# EasyEDA Pro project ProProject_Avaota Pi A_2024-03-25.epro, board PCB2
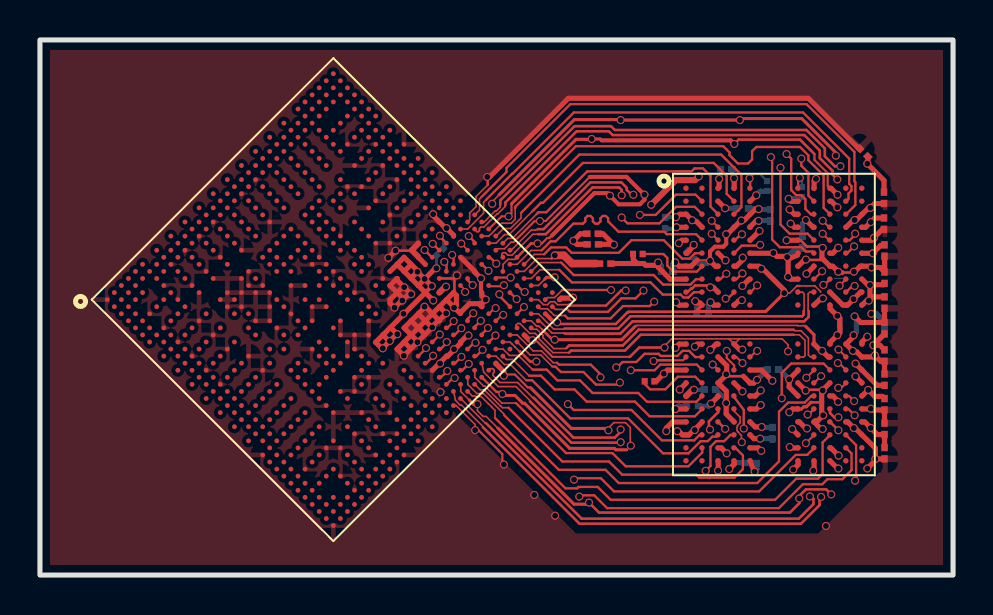
[diagram p19: board, top side]
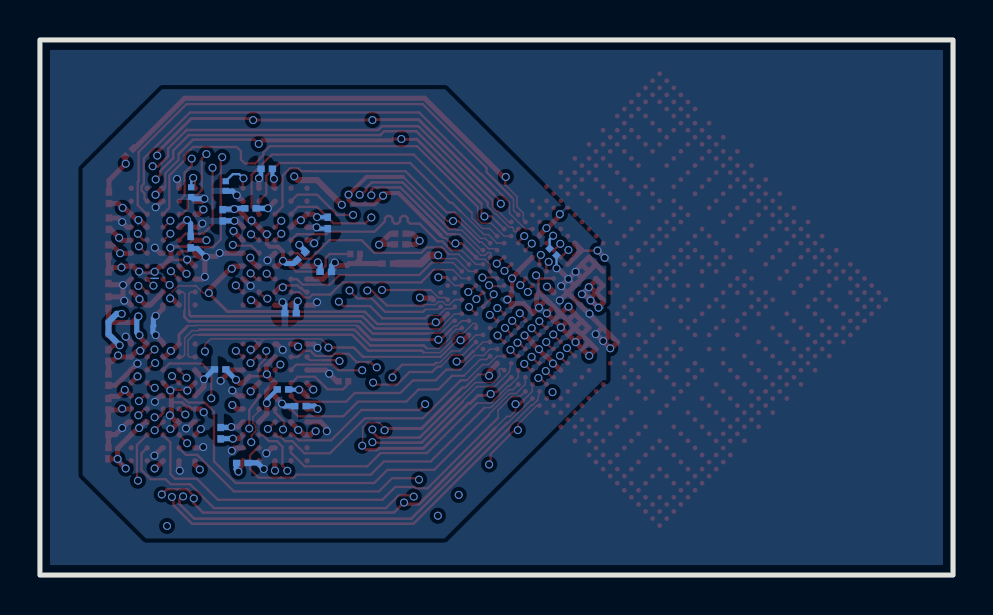
[diagram p20: board, bottom side, seen from below]

Outline 45.69 x 26.8 mm; copper layers: Top Layer, Inner1, Inner2, Bottom Layer. Coordinates in mm from the lower left corner of the outline.
Outline path: rectangle 0,26.8 45.69,0
Stack: Top Layer 0.035mm 外层铜厚1oz / Dielectric1 0.2104mm 7628 RC49% 8.6mil / Inner1 0.0152mm 内层铜厚 / Dielectric2 1.065mm 1.1mm H/HOZ 含铜 / Inner2 0.0152mm 内层铜厚 / Dielectric3 0.2104mm 7628 RC49% 8.6mil / Bottom Layer 0.035mm 外层铜厚1oz

## Design rules (mm)
template: 6L BGA
spacing safeClearance (default): track to track 0.076, other pairs 0.076 to 0.3
track width trackWidth (default): min 0.076, default 0.102, max 2.54
differential pair differentialPair (default): width min 0.102, default 0.254, max 2.54; gap min 0.102, default 0.102
via viaSize (default): diameter min 0.381, default 0.45, max 10; hole min 0.201, default 0.201, max 5.999
net GND uses DRAMCopper
pour e3959 uses DRAMCopper
pour e3975 uses DRAMCopper

## Placement (name value [footprint] x y rotation side)
C1  2.2uF  [c0201 nsk]  42.27 13.64 270 top
C2  2.2uF  [c0201 nsk]  42.27 6.1 270 top
C3  100nF  [c0201 nsk]  42.27 14.88 270 top
C4  100nF  [c0201 nsk]  42.27 9.78 270 top
C5  100nF  [c0201 nsk]  28.3 15.6 0 top
C6  2.2uF  [c0201 nsk]  41.22 21.16 135 top
C7  100nF  [c0201 nsk]  42.24 18.9 90 top
C8  2.2uF  [c0201 nsk]  42.27 12.37 90 top
C9  100nF  [c0201 nsk]  42.27 16.26 90 top
C10  100nF  [c0201 nsk]  32.61 15.98 135 bottom
C11  100nF  [c0201 nsk]  42.27 8.56 90 top
C12  100nF  [c0201 nsk]  42.27 11 90 top
C13  100nF  [c0201 nsk]  33.53 9.3 180 bottom
C14  2.2uF  [c0201 nsk]  34.34 20.34 180 bottom
C15  2.2uF  [c0201 nsk]  33.15 13.11 180 bottom
C16  100nF  [c0201 nsk]  31.29 17.63 270 bottom
C17  100nF  [c0201 nsk]  42.24 17.6 90 top
C18  100nF  [c0201 nsk]  42.27 7.31 270 top
C19  2.2uF  [c0201 nsk]  31.39 15.19 0 bottom
C20  100nF  [c0201 nsk]  36.68 10.3 0 bottom
C21  100nF  [c0201 nsk]  35.56 5.61 180 bottom
C22  100nF  [c0201 nsk]  32.66 8.46 0 bottom
C23  100nF  [c0201 nsk]  38.15 16.66 270 bottom
C24  100nF  [c0201 nsk]  36.65 7.11 90 bottom
C25  100nF  [c0201 nsk]  36.55 18.01 270 bottom
C26  100nF  [c0201 nsk]  35.15 18.36 180 bottom
C27  2.2uF  [c0201 nsk]  27.66 17.09 0 top
C28  100nF  [c0201 nsk]  27.66 16.56 180 top
R1  0  [r0201 nsk]  29.92 16.08 180 top
R2  0  [r0201 nsk]  30.51 9.7 0 top
R3  120  [r0201 nsk]  20.01 16.18 225 bottom
R4  240  [r0201 nsk]  36.4 19.48 270 bottom
R5  240  [r0201 nsk]  38.13 19.18 270 bottom
U1  T527  [T527-BGA664]  14.68 13.79 45 top
UD1  LPDDR4_FBGA200  [BGA200P65_80B1000_1500H90]  36.73 12.55 0 top

## Footprints (pads in the part's own frame, mm; a bottom-side part is the same pattern mirrored in y, then rotated)
BGA200P65_80B1000_1500H90
  round 0.27 smd: A1(-4.4,6.825) A2(-3.6,6.825) A3(-2.8,6.825) A4(-2,6.825) A5(-1.2,6.825) A8(1.2,6.825) A9(2,6.825) A10(2.8,6.825) A11(3.6,6.825) A12(4.4,6.825) AA1(-4.4,-6.175) AA2(-3.6,-6.175) AA3(-2.8,-6.175) AA4(-2,-6.175) AA5(-1.2,-6.175) AA8(1.2,-6.175) AA9(2,-6.175) AA10(2.8,-6.175) AA11(3.6,-6.175) AA12(4.4,-6.175) AB1(-4.4,-6.825) AB2(-3.6,-6.825) AB3(-2.8,-6.825) AB4(-2,-6.825) AB5(-1.2,-6.825) AB8(1.2,-6.825) AB9(2,-6.825) AB10(2.8,-6.825) AB11(3.6,-6.825) AB12(4.4,-6.825) B1(-4.4,6.175) B2(-3.6,6.175) B3(-2.8,6.175) B4(-2,6.175) B5(-1.2,6.175) B8(1.2,6.175) B9(2,6.175) B10(2.8,6.175) B11(3.6,6.175) B12(4.4,6.175) C1(-4.4,5.525) C2(-3.6,5.525) C3(-2.8,5.525) C4(-2,5.525) C5(-1.2,5.525) C8(1.2,5.525) C9(2,5.525) C10(2.8,5.525) C11(3.6,5.525) C12(4.4,5.525) D1(-4.4,4.875) D2(-3.6,4.875) D3(-2.8,4.875) D4(-2,4.875) D5(-1.2,4.875) D8(1.2,4.875) D9(2,4.875) D10(2.8,4.875) D11(3.6,4.875) D12(4.4,4.875) E1(-4.4,4.225) E2(-3.6,4.225) E3(-2.8,4.225) E4(-2,4.225) E5(-1.2,4.225) E8(1.2,4.225) E9(2,4.225) E10(2.8,4.225) E11(3.6,4.225) E12(4.4,4.225) F1(-4.4,3.575) F2(-3.6,3.575) F3(-2.8,3.575) F4(-2,3.575) F5(-1.2,3.575) F8(1.2,3.575) F9(2,3.575) F10(2.8,3.575) F11(3.6,3.575) F12(4.4,3.575) G1(-4.4,2.925) G2(-3.6,2.925) G3(-2.8,2.925) G4(-2,2.925) G5(-1.2,2.925) G8(1.2,2.925) G9(2,2.925) G10(2.8,2.925) G11(3.6,2.925) G12(4.4,2.925) H1(-4.4,2.275) H2(-3.6,2.275) H3(-2.8,2.275) H4(-2,2.275) H5(-1.2,2.275) H8(1.2,2.275) H9(2,2.275) H10(2.8,2.275) H11(3.6,2.275) H12(4.4,2.275) J1(-4.4,1.625) J2(-3.6,1.625) J3(-2.8,1.625) J4(-2,1.625) J5(-1.2,1.625) J8(1.2,1.625) J9(2,1.625) J10(2.8,1.625) J11(3.6,1.625) J12(4.4,1.625) K1(-4.4,0.975) K2(-3.6,0.975) K3(-2.8,0.975) K4(-2,0.975) K5(-1.2,0.975) K8(1.2,0.975) K9(2,0.975) K10(2.8,0.975) K11(3.6,0.975) K12(4.4,0.975) N1(-4.4,-0.975) N2(-3.6,-0.975) N3(-2.8,-0.975) N4(-2,-0.975) N5(-1.2,-0.975) N8(1.2,-0.975) N9(2,-0.975) N10(2.8,-0.975) N11(3.6,-0.975) N12(4.4,-0.975) P1(-4.4,-1.625) P2(-3.6,-1.625) P3(-2.8,-1.625) P4(-2,-1.625) P5(-1.2,-1.625) P8(1.2,-1.625) P9(2,-1.625) P10(2.8,-1.625) P11(3.6,-1.625) P12(4.4,-1.625) R1(-4.4,-2.275) R2(-3.6,-2.275) R3(-2.8,-2.275) R4(-2,-2.275) R5(-1.2,-2.275) R8(1.2,-2.275) R9(2,-2.275) R10(2.8,-2.275) R11(3.6,-2.275) R12(4.4,-2.275) T1(-4.4,-2.925) T2(-3.6,-2.925) T3(-2.8,-2.925) T4(-2,-2.925) T5(-1.2,-2.925) T8(1.2,-2.925) T9(2,-2.925) T10(2.8,-2.925) T11(3.6,-2.925) T12(4.4,-2.925) U1(-4.4,-3.575) U2(-3.6,-3.575) U3(-2.8,-3.575) U4(-2,-3.575) U5(-1.2,-3.575) U8(1.2,-3.575) U9(2,-3.575) U10(2.8,-3.575) U11(3.6,-3.575) U12(4.4,-3.575) V1(-4.4,-4.225) V2(-3.6,-4.225) V3(-2.8,-4.225) V4(-2,-4.225) V5(-1.2,-4.225) V8(1.2,-4.225) V9(2,-4.225) V10(2.8,-4.225) V11(3.6,-4.225) V12(4.4,-4.225) W1(-4.4,-4.875) W2(-3.6,-4.875) W3(-2.8,-4.875) W4(-2,-4.875) W5(-1.2,-4.875) W8(1.2,-4.875) W9(2,-4.875) W10(2.8,-4.875) W11(3.6,-4.875) W12(4.4,-4.875) Y1(-4.4,-5.525) Y2(-3.6,-5.525) Y3(-2.8,-5.525) Y4(-2,-5.525) Y5(-1.2,-5.525) Y8(1.2,-5.525) Y9(2,-5.525) Y10(2.8,-5.525) Y11(3.6,-5.525) Y12(4.4,-5.525)
c0201 nsk
  rect 0.368x0.324 smd: 1(-0.292,0) 2(0.28,0)
r0201 nsk
  rect 0.303x0.324 smd: 1(-0.241,0) 2(0.241,0)
T527-BGA664
  round 0.239 smd: A1(-8,8) A2(-7.5,8) A3(-7,8) A4(-6.5,8) A5(-6,8) A6(-5.5,8) A8(-4.5,8) A10(-3.5,8) A12(-2.5,8) A14(-1.5,8) A16(-0.5,8) A18(0.5,8) A20(1.5,8) A22(2.5,8) A24(3.5,8) A26(4.5,8) A28(5.5,8) A29(6,8) A30(6.5,8) A31(7,8) A32(7.5,8) A33(8,8) AA1(-8,-2) AA2(-7.5,-2) AA3(-7,-2) AA4(-6.5,-2) AA5(-6,-2) AA6(-5.5,-2) AA7(-5,-2) AA9(-4,-2) AA12(-2.5,-2) AA13(-2,-2) AA15(-1,-2) AA16(-0.5,-2) AA18(0.5,-2) AA19(1,-2) AA21(2,-2) AA22(2.5,-2) AA24(3.5,-2) AA26(4.5,-2) AA27(5,-2) AA28(5.5,-2) AA29(6,-2) AA30(6.5,-2) AA31(7,-2) AA32(7.5,-2) AA33(8,-2) AB2(-7.5,-2.501) AB3(-7,-2.5) AB9(-4,-2.501) AB10(-3.5,-2.5) AB11(-3,-2.5) AB12(-2.5,-2.5) AB13(-2,-2.5) AB14(-1.5,-2.5) AB15(-1,-2.5) AB17(0,-2.5) AB24(3.5,-2.5) AB32(7.5,-2.501) AB33(8,-2.5) AC1(-8,-3) AC2(-7.5,-3) AC3(-7,-3) AC4(-6.5,-3) AC5(-6,-3) AC6(-5.5,-3) AC7(-5,-3) AC9(-4,-3) AC15(-1,-3) AC17(0,-3) AC18(0.5,-3) AC19(1,-3) AC20(1.5,-3) AC22(2.5,-3) AC24(3.5,-3) AC26(4.5,-3) AC27(5,-3) AC28(5.5,-3) AC29(6,-3) AC30(6.5,-3) AC31(7,-3) AC32(7.5,-3) AC33(8,-3) AD1(-8,-3.5) AD2(-7.5,-3.5) AD9(-4,-3.5) AD11(-3,-3.5) AD13(-2,-3.5) AD14(-1.5,-3.5) AD15(-1,-3.5) AD20(1.5,-3.5) AD21(2,-3.5) AD22(2.5,-3.5) AD25(4,-3.5) AD32(7.5,-3.5) AD33(8,-3.5) AE1(-8,-4) AE2(-7.5,-4) AE3(-7,-4) AE4(-6.5,-4) AE5(-6,-4) AE6(-5.5,-4) AE7(-5,-4) AE9(-4,-4) AE11(-3,-4) AE12(-2.501,-4) AE13(-2,-4) AE14(-1.5,-4) AE16(-0.5,-4) AE18(0.5,-4) AE19(1,-4) AE20(1.5,-4) AE21(2,-4) AE22(2.501,-4) AE23(3,-4) AE24(3.5,-4) AE25(4,-4) AE26(4.5,-4) AE27(5,-4) AE28(5.5,-4) AE29(6,-4) AE30(6.5,-4) AE31(7,-4) AE32(7.5,-4) AE33(8,-4) AF1(-8,-4.5) AF2(-7.5,-4.5) AF32(7.5,-4.5) AF33(8,-4.5) AG1(-8,-5) AG2(-7.5,-5) AG3(-7,-5) AG4(-6.5,-5) AG5(-6,-5) AG6(-5.5,-5) AG7(-5,-5) AG9(-4,-5) AG11(-3,-5) AG13(-2,-5) AG15(-1,-5) AG17(0,-5) AG19(1,-5) AG21(2,-5) AG23(3,-5) AG25(4,-5) AG28(5.5,-5) AG29(6,-5) AG30(6.5,-5) AG31(7,-5) AG32(7.5,-5) AG33(8,-5) AH1(-8,-5.5) AH2(-7.5,-5.5) AH7(-5,-5.5) AH9(-4,-5.5) AH11(-3,-5.5) AH13(-2,-5.5) AH15(-1,-5.5) AH17(0,-5.5) AH19(1,-5.5) AH21(2,-5.5) AH23(3,-5.5) AH25(4,-5.5) AH27(5,-5.5) AH32(7.5,-5.5) AH33(8,-5.5) AJ1(-8,-6) AJ2(-7.5,-6) AJ3(-7,-6) AJ4(-6.5,-6) AJ5(-6,-6) AJ7(-5,-6) AJ9(-4,-6) AJ11(-3,-6) AJ13(-2,-6) AJ15(-1,-6) AJ17(0,-6) AJ19(1,-6) AJ21(2,-6) AJ23(3,-6) AJ25(4,-6) AJ27(5,-6) AJ30(6.5,-6) AJ31(7,-6) AJ32(7.5,-6) AJ33(8,-6) AK1(-8,-6.5) AK2(-7.5,-6.5) AK5(-6,-6.5) AK7(-5,-6.5) AK9(-4,-6.5) AK11(-3,-6.5) AK13(-2,-6.5) AK15(-1,-6.5) AK17(0,-6.501) AK19(1,-6.5) AK21(2,-6.5) AK23(3,-6.5) AK25(4,-6.5) AK27(5,-6.5) AK29(6,-6.5) AK32(7.5,-6.5) AK33(8,-6.5) AL1(-8,-7) AL2(-7.5,-7) AL3(-7,-7) AL5(-6,-7) AL7(-5,-7) AL9(-4,-7) AL11(-3,-7) AL12(-2.5,-7) AL13(-2,-7) AL14(-1.5,-7) AL15(-1,-7) AL16(-0.5,-7) AL17(0,-7) AL19(1,-7) AL21(2,-7) AL23(3,-7) AL25(4,-7) AL27(5,-7) AL29(6,-7) AL31(7,-7) AL32(7.5,-7) AL33(8,-7) AM1(-8,-7.5) AM2(-7.5,-7.5) AM3(-7,-7.5) AM4(-6.5,-7.5) AM5(-6,-7.5) AM6(-5.5,-7.5) AM7(-5,-7.5) AM8(-4.5,-7.5) AM9(-4,-7.5) AM10(-3.5,-7.5) AM11(-3,-7.5) AM12(-2.501,-7.5) AM13(-2,-7.5) AM14(-1.5,-7.5) AM15(-1,-7.5) AM16(-0.5,-7.5) AM17(0,-7.5) AM18(0.5,-7.5) AM19(1,-7.5) AM20(1.5,-7.5) AM21(2,-7.5) AM22(2.501,-7.5) AM23(3,-7.5) AM24(3.5,-7.5) AM25(4,-7.5) AM26(4.5,-7.5) AM27(5,-7.5) AM28(5.5,-7.5) AM29(6,-7.5) AM30(6.5,-7.5) AM31(7,-7.5) AM32(7.5,-7.5) AM33(8,-7.5) AN1(-8,-8) AN2(-7.5,-8) AN3(-7,-8) AN4(-6.5,-8) AN5(-6,-8) AN6(-5.5,-8) AN7(-5,-8) AN8(-4.5,-8) AN9(-4,-8) AN10(-3.5,-8) AN11(-3,-8) AN13(-2,-8) AN15(-1,-8) AN17(0,-8) AN18(0.5,-8) AN19(1,-8) AN20(1.5,-8) AN21(2,-8) AN22(2.5,-8) AN23(3,-8) AN24(3.5,-8) AN25(4,-8) AN26(4.5,-8) AN27(5,-8) AN28(5.5,-8) AN29(6,-8) AN30(6.5,-8) AN31(7,-8) AN32(7.5,-8) AN33(8,-8) B1(-8,7.5) B2(-7.5,7.5) B3(-7,7.5) B4(-6.5,7.5) B5(-6,7.5) B6(-5.5,7.5) B7(-5,7.5) B8(-4.5,7.5) B9(-4,7.5) B10(-3.5,7.5) B11(-3,7.5) B12(-2.501,7.5) B13(-2,7.5) B14(-1.5,7.5) B15(-1,7.5) B16(-0.5,7.5) B17(0,7.5) B18(0.5,7.5) B19(1,7.5) B20(1.5,7.5) B21(2,7.5) B22(2.501,7.5) B23(3,7.5) B24(3.5,7.5) B25(4,7.5) B26(4.5,7.5) B27(5,7.5) B28(5.5,7.5) B29(6,7.5) B30(6.5,7.5) B31(7,7.5) B32(7.5,7.5) B33(8,7.5) C1(-8,7) C2(-7.5,7) C3(-7,7) C4(-6.5,7) C6(-5.5,7) C7(-5,7) C8(-4.5,7) C9(-4,7) C10(-3.5,7) C11(-3,7) C12(-2.5,7) C13(-2,7) C14(-1.5,7) C15(-1,7) C16(-0.5,7) C17(0,7) C18(0.5,7) C19(1,7) C20(1.5,7) C21(2,7) C22(2.5,7) C23(3,7) C24(3.5,7) C25(4,7) C26(4.5,7) C27(5,7) C28(5.5,7) C29(6,7) C30(6.5,7) C31(7,7) C32(7.5,7) C33(8,7) D1(-8,6.5) D2(-7.5,6.5) D6(-5.5,6.5) D8(-4.5,6.5) D10(-3.5,6.5) D12(-2.5,6.501) D14(-1.5,6.5) D16(-0.5,6.5) D18(0.5,6.5) D20(1.5,6.5) D22(2.5,6.501) D24(3.5,6.5) D26(4.5,6.5) D28(5.5,6.5) D32(7.5,6.5) D33(8,6.5) E1(-8,6) E2(-7.5,6) E3(-7,6) E4(-6.5,6) E5(-6,6) E6(-5.5,6) E8(-4.5,6) E10(-3.5,6) E12(-2.5,6) E14(-1.5,6) E16(-0.5,6) E18(0.5,6) E20(1.5,6) E22(2.5,6) E24(3.5,6) E26(4.5,6) E28(5.5,6) E29(6,6) E30(6.5,6) E31(7,6) E32(7.5,6) E33(8,6) F1(-8,5.5) F2(-7.5,5.5) F6(-5.5,5.5) F8(-4.5,5.5) F10(-3.5,5.5) F12(-2.5,5.5) F14(-1.5,5.5) F16(-0.5,5.5) F18(0.5,5.5) F20(1.5,5.5) F22(2.5,5.5) F24(3.5,5.5) F26(4.5,5.5) F28(5.5,5.5) F32(7.5,5.5) F33(8,5.5) G1(-8,5) G2(-7.5,5) G3(-7,5) G4(-6.5,5) G5(-6,5) G6(-5.5,5) G8(-4.5,5) G10(-3.5,5) G12(-2.5,5) G14(-1.5,5) G16(-0.5,5) G18(0.5,5) G20(1.5,5) G22(2.5,5) G24(3.5,5) G26(4.5,5) G28(5.5,5) G29(6,5) G30(6.5,5) G31(7,5) G32(7.5,5) G33(8,5) H2(-7.5,4.5) H3(-7,4.5) H24(3.5,4.5) H31(7,4.5) H32(7.5,4.5) J1(-8,4) J2(-7.5,4) J3(-7,4) J4(-6.5,4) J5(-6,4) J6(-5.5,4) J7(-5,4) J9(-4,4) J10(-3.5,4) J12(-2.501,4) J13(-2,4) J15(-1,4) J16(-0.5,4) J17(0,4) J18(0.5,4) J19(1,4) J21(2,4) J22(2.501,4) J23(3,4) J26(4.5,4) J28(5.5,4) J29(6,4) J30(6.5,4) J31(7,4) J32(7.5,4) J33(8,4) K2(-7.5,3.5) K3(-7,3.5) K9(-4,3.5) K10(-3.5,3.5) K11(-3,3.5) K12(-2.5,3.5) K13(-2,3.5) K15(-1,3.5) K16(-0.5,3.5) K19(1,3.5) K21(2,3.5) K22(2.5,3.5) K24(3.5,3.5) K25(4,3.5) K26(4.5,3.5) K31(7,3.5) K32(7.5,3.5) L1(-8,3) L2(-7.5,3) L3(-7,3) L4(-6.5,3) L5(-6,3) L6(-5.5,3) L7(-5,3) L9(-4,3) L10(-3.5,3) L12(-2.5,3) L13(-2,3) L15(-1,3) L16(-0.5,3) L17(0,3) L18(0.5,3) L19(1,3) L21(2,3) L22(2.5,3) L24(3.5,3) L26(4.5,3) L27(5,3) L28(5.5,3) L29(6,3) L30(6.5,3) L31(7,3) L32(7.5,3) L33(8,3) M2(-7.5,2.501) M3(-7,2.5) M10(-3.5,2.5) M13(-2,2.5) M16(-0.5,2.5) M18(0.5,2.5) M19(1,2.5) M21(2,2.5) M22(2.5,2.5) M31(7,2.5) M32(7.5,2.501) N1(-8,2) N2(-7.5,2) N3(-7,2) N4(-6.5,2) N5(-6,2) N6(-5.5,2) N7(-5,2) N9(-4,2) N10(-3.5,2) N12(-2.5,2) N13(-2,2) N15(-1,2) N18(0.5,2) N19(1,2) N21(2,2) N22(2.5,2) N24(3.5,2) N26(4.5,2) N27(5,2) N28(5.5,2) N29(6,2) N30(6.5,2) N31(7,2) N32(7.5,2) N33(8,2) P2(-7.5,1.5) P3(-7,1.5) P9(-4,1.5) P11(-3,1.5) P13(-2,1.5) P16(-0.5,1.5) P18(0.5,1.5) P19(1,1.5) P21(2,1.5) P22(2.5,1.5) P24(3.5,1.5) P31(7,1.5) P32(7.5,1.5) R1(-8,1) R2(-7.5,1) R3(-7,1) R4(-6.5,1) R5(-6,1) R6(-5.5,1) R7(-5,1) R11(-3,1) R13(-2,1) R15(-1,1) R17(0,1) R18(0.5,1) R19(1,1) R22(2.5,1) R24(3.5,1) R26(4.5,1) R27(5,1) R28(5.5,1) R29(6,1) R30(6.5,1) R31(7,1) R32(7.5,1) R33(8,1) T2(-7.5,0.5) T3(-7,0.5) T9(-4,0.5) T11(-3,0.5) T13(-2,0.5) T15(-1,0.5) T16(-0.5,0.5) T18(0.5,0.5) T19(1,0.5) T21(2,0.5) T22(2.5,0.5) T24(3.5,0.5) T31(7,0.5) T32(7.5,0.5) U1(-8,0) U2(-7.5,0) U3(-7,0) U4(-6.501,0) U5(-6,0) U6(-5.5,0) U7(-5,0) U8(-4.5,0) U10(-3.5,0) U12(-2.5,0) U13(-2,0) U14(-1.5,0) U16(-0.5,0) U18(0.5,0) U19(1,0) U21(2,0) U22(2.5,0) U25(4,0) U26(4.5,0) U27(5,0) U28(5.5,0) U29(6,0) U30(6.501,0) U31(7,0) U32(7.5,0) U33(8,0) V2(-7.5,-0.5) V3(-7,-0.5) V18(0.5,-0.5) V19(1,-0.5) V31(7,-0.5) V32(7.5,-0.5) W1(-8,-1) W2(-7.5,-1) W3(-7,-1) W4(-6.5,-1) W5(-6,-1) W6(-5.5,-1) W7(-5,-1) W9(-4,-1) W10(-3.5,-1) W12(-2.5,-1) W13(-2,-1) W15(-1,-1) W16(-0.5,-1) W19(1,-1) W21(2,-1) W22(2.5,-1) W23(3,-1) W24(3.5,-1) W25(4,-1) W27(5,-1) W28(5.5,-1) W29(6,-1) W30(6.5,-1) W31(7,-1) W32(7.5,-1) W33(8,-1) Y2(-7.5,-1.5) Y3(-7,-1.5) Y9(-4,-1.5) Y10(-3.5,-1.5) Y12(-2.5,-1.5) Y13(-2,-1.5) Y15(-1,-1.5) Y18(0.5,-1.5) Y19(1,-1.5) Y21(2,-1.5) Y22(2.5,-1.5) Y23(3,-1.5) Y24(3.5,-1.5) Y26(4.5,-1.5) Y31(7,-1.5) Y32(7.5,-1.5)

## Nets
As in the schematic.

Pads without a net: U1 A2 A3 A4 A5 A6 A8 A10 A12 A14 A16 A18 A20 A22 A24 A26 A28 A29 A30 A31 A32 A33 AA1 AA2 AA3 AA4 AA5 AA6 AA7 AA9 AA12 AA13 AA19 AB2 AB3 AB9 AB13 AC2 AC3 AC4 AC5 AC6 AC7 AC9 AC15 AD1 AD2 AD15 AE1 AE2 AE3 AE4 AE5 AE6 AE7 AE11 AE13 AE16 AF1 AF2 AG1 AG2 AG4 AG5 AG9 AG13 AG15 AG17 AH1 AH2 AH11 AH13 AH15 AH17 AJ1 AJ2 AJ3 AJ4 AJ5 AJ7 AJ9 AJ11 AJ15 AJ17 AK1 AK2 AK7 AK9 AK13 AK15 AK17 AK33 AL1 AL2 AL5 AL7 AL11 AL15 AL16 AL17 AL27 AL32 AL33 AM1 AM2 AM3 AM4 AM6 AM7 AM8 AM9 AM10 AM11 AM12 AM13 AM14 AM15 AM16 AM17 AM18 AM33 AN2 AN3 AN4 AN5 AN6 AN7 AN8 AN9 AN13 AN15 AN17 AN26 B1 B2 B3 B4 B5 B6 B7 B8 B9 B10 B11 B12 B13 B14 B15 B16 B17 B18 B19 B20 B21 B22 B23 B24 B25 B26 B27 B28 B29 B30 B31 B32 B33 C1 C2 C3 C4 C7 C9 C11 C13 C15 C16 C17 C19 C21 C22 C23 C24 C25 C26 C27 C28 C29 C30 C31 C32 C33 D1 D2 D8 D10 D12 D14 D16 D18 D20 D22 D24 D26 D28 D32 D33 E1 E2 E4 E5 E6 E8 E10 E12 E14 E16 E18 E20 E22 E24 E26 E28 E29 E30 E31 E32 E33 F1 F2 F14 F16 F18 F20 F22 F24 F26 F28 F32 F33 G1 G2 G4 G5 G6 G12 G16 G20 G22 G24 G26 G28 G30 G31 G32 G33 H2 H3 H24 H31 H32 J1 J2 J4 J5 J7 J15 J16 J17 J18 J19 J21 J22 J23 J26 J29 J30 J32 J33 K2 K3 K13 K15 K16 K19 K21 K22 K24 K25 K31 K32 L1 L2 L4 L5 L7 L9 L15 L16 L17 L18 L19 L21 L22 L24 L26 L28 L29 L31 L32 M2 M3 M10 M16 M18 M19 M21 M22 M31 M32 N1 N2 N4 N5 N7 N9 N13 N21 N24 N28 N29 N31 N32 N33 P2 P3 P9 P13 P18 P21 P22 P31 P32 R1 R2 R4 R5 R6 R15 R17 R18 R22 R26 R28 R29 R30 R31 R32 R33 T2 T3 T9 T11 T13 T19 T21 T22 T31 T32 U1 U2 U3 U4 U5 U6 U8 U10 U12 U13 U18 U19 U21 U22 U26 U28 U29 U30 U31 U32 U33 V2 V3 V31 V32 W1 W2 W3 W4 W5 W6 W7 W9 W10 W19 W21 W28 W29 W31 W32 W33 Y2 Y3 Y9 Y10 Y12 Y13 Y19 Y21 Y31 Y32; UD1 A1 A2 A11 A12 AA1 AA12 AB1 AB2 AB11 AB12 B1 B12 G11 K5 K8 N5 N8

## Via types
v1: diameter 0.4, hole 0.3, Top Layer to Bottom Layer, 283 vias

## Routing (per net, layer and track width the routed paths; a pad name or vN(x,y) marks a point on that pad's centre or on a via; arc(x,y) is an arc through that point)
GND: length 299.7
  Top Layer w0.076: 21.41,17.68 21.5,17.78 21.5,18.13 21.82,18.45 21.82,18.95 22.41,19.54 ; v1(22.63,18.59) 22.63,18.7 22.97,19.04 ; 23.88,15.21 24.24,15.21 24.88,15.85 25.61,15.85 ; 29.82,12.49 29.87,12.49 29.88,12.5 37.9,12.5 37.91,12.49 38.29,12.49 ; 21.49,8.76 21.05,9.2 21.05,9.55 ; 25.14,12.29 24.96,12.47 24.87,12.47 24.84,12.48 24.59,12.73 24.24,12.73 ; 37.89,14.48 37.88,14.48 37.52,14.12 v1(37.24,14.12) ; 22.82,16.27 22.9,16.34 23.25,16.34 23.58,16.67 23.7,16.67 ; 24,11.2 23.78,11.42 23.78,11.42 23.63,11.57 23.63,11.57 23.52,11.67 23.17,11.67 ; 20.7,8.49 20.83,8.49 21.78,7.54 v1(21.78,7.26) ; 32.9,15.77 33.5,15.77 v1(33.53,15.74) ; v1(21.89,8.56) 21.89,8.23 22.18,7.94 22.33,7.94 22.92,7.36 ; v1(37.44,11.2) 37.44,11.53 37.14,11.83 35,11.83 ; 22.37,19.79 22.37,19.94 v1(22.38,19.94) 22.39,19.93 ; 39.06,14.17 39.06,14.2 38.78,14.48 38.01,14.48 ; 35,11.83 34.74,11.57 34.48,11.83 ; 35,11.83 34.48,11.83 ; v1(31.26,11.39) 31.26,11.47 31.61,11.83 34.48,11.83 ; 23.88,15.91 23.78,15.81 23.43,15.81 23.17,15.56 23.17,15.21 ; 24.59,14.5 24.94,14.5 25.26,14.82 ; v1(29.57,6.48) 29.54,6.5 29.54,7.39 29.3,7.63 28.71,7.63 28.42,7.34 ; v1(28.45,7.25) 28.54,7.25
  Top Layer w0.102: 29.48,10.93 25.65,10.93 24.81,11.76 v1(24.65,11.76) ; 39.54,19.37 39.42,19.49 39.42,20.13 38.76,20.79 38.76,21.08 ; 23.6,18.59 23.6,18.1 v1(23.45,17.96) 23.45,17.96 23.1,17.96 22.47,17.33 ; 24.56,9.37 24.54,9.4 24.41,9.4 23.76,10.05 23.11,10.05 ; 32.34,10.92 32.18,10.76 31.55,10.76 ; 23.7,16.67 24.75,17.72 25.01,17.72 v1(25.02,17.73) 25.31,17.73 27.52,19.94 ; 38.29,12.49 38.33,12.45 ; v1(21.78,7.26) 21.94,7.26 22.97,6.23 22.97,6.23 23.14,6.06 23.14,5.61 v1(23.22,5.54) ; 25.62,17 25.52,16.9 25.48,16.9 25.46,16.88 25.39,16.88 25.12,16.61 v1(24.9,16.61) ; 37.89,14.48 38.01,14.48 ; 29.78,12.45 29.82,12.49
  Top Layer w0.115: 22.11,9.9 22.85,9.17 23.04,9.17 v1(23.14,9.07)
  Top Layer w0.127: 22.39,19.93 22.36,19.89 22.41,19.84 22.41,19.54 ; v1(39.6,4.04) 39.34,4.29 38.33,4.29 38,3.96 v1(38,3.84) 38,3.6 37.53,3.13 27.98,3.13 v1(27.47,3.63) ; v1(30.71,10.72) 30.75,10.76 31.55,10.76 ; 20.74,14.88 20.74,14.19 20.7,14.15 ; 20.74,14.88 v1(20.87,15.01) ; 20.74,14.88 20.71,14.85 19.99,14.85 ; 39.23,15.78 38.35,15.78 v1(38.33,15.8) ; v1(24.9,16.61) 24.58,16.61 23.88,15.91 ; 25.14,12.29 25.64,11.79 v1(25.76,11.79) ; v1(25.88,12.66) 25.97,12.57 28.82,12.57 29.4,13.15 29.42,13.15 29.46,13.19 32.92,13.19 32.95,13.21 ; 35.2,9.96 34.44,9.96 v1(34.34,10.05) ; 40.13,15.15 40.73,15.15 ; v1(33.54,14.41) 33.45,14.5 32.79,14.5 32.64,14.35 32.59,14.35 32.4,14.17 32.34,14.17 ; 39.12,8.67 39.1,8.65 38.63,8.65 ; 29.48,10.93 29.52,10.93 29.99,11.39 v1(31.26,11.39) ; 38.76,21.08 38.03,21.81 34.96,21.81 v1(34.75,21.59) ; v1(17.79,16.25) 17.8,16.24 18.6,16.24 ; 25.61,15.85 v1(25.77,16.01) ; 37.94,16.77 38.06,16.77 38.38,16.45 39.05,16.45 39.12,16.38 v1(39.17,16.38) ; v1(39.17,9.25) 39.14,9.28 38.36,9.28 v1(38.32,9.24) ; 24,11.2 24.03,11.2 24.53,10.69 v1(24.84,10.69)
  Top Layer w0.152: v1(25.76,11.79) 29.12,11.79 29.78,12.45 ; 37.94,8.32 38.11,8.32 38.22,8.43 38.36,8.43 38.58,8.65 38.63,8.65 ; 28.42,7.34 26.59,7.34 24.56,9.37 ; 38.33,12.45 38.74,12.04 38.74,11.58 UD1.N9 ; v1(21.89,8.56) 21.69,8.56 21.49,8.76 ; v1(37.24,14.12) 36.32,13.2 32.83,13.2 33.14,13.52 ; 25.26,14.82 25.35,14.91 v1(25.76,14.91) ; 23.6,18.59 26.82,21.82 27.59,21.82 v1(27.61,21.84) 28.04,21.84 28.11,21.77 ; v1(23.14,9.07) 23.21,9 23.77,9 24.16,8.6 24.25,8.6 26.51,6.34 28.75,6.34 28.82,6.27 29.36,6.27 ; v1(39.83,21.01) 39.83,21.16 38.12,22.86 35.1,22.86 v1(35.03,22.78) v1(29.06,22.78) 28.96,22.78 28.93,22.81 26.74,22.81 22.97,19.04 ; 22.92,7.36 26.72,3.55 27.33,3.55 27.42,3.63 v1(27.47,3.63)
  Top Layer w0.203: 27.52,19.94 29.35,19.94 30.24,19.05 v1(30.25,19.05) 30.25,18.8 30.02,18.57 28.96,18.57 v1(28.52,19) 28.4,19.13 27.75,19.13 25.62,17 ; 28.11,21.77 34.57,21.77 v1(34.75,21.59) ; 22.11,14.15 22.07,14.19 v1(22.07,14.86) ; 25.3,13.09 25.72,12.66 v1(25.88,12.66) ; v1(34.34,17.07) 34.34,16.59 34.2,16.44 33.78,16.44 33.53,16.2 v1(33.53,15.74)
  Top Layer w0.254: 18.59,11.36 v1(18.89,11.66) 18.89,11.71 ; 18.59,11.36 v1(18.21,10.98) 17.87,11.32 18.22,11.67 ; 18.59,11.36 18.54,11.36 18.22,11.67 ; 38.74,11.57 39.08,11.23 v1(39.14,11.23) 39.45,10.92 39.54,10.92 ; v1(35.76,5.18) 35.74,5.2 35.54,5.69 35.54,5.72 ; v1(34.34,17.07) 34.39,17.07 35.08,17.75 v1(35.1,17.75) 35.13,17.78 35.26,17.78 35.8,18.33 v1(35.97,18.33) ; 33.14,17.42 32.84,17.71 32.69,17.71 v1(32.64,17.77) 32.34,18.07 32.01,18.07 31.87,17.92 v1(31.83,17.92) ; 19.99,13.44 20.35,13.79 ; 19.99,13.44 v1(20.33,13.1) 19.98,12.76 19.98,12.74 ; 19.99,13.44 19.64,13.09 ; 20.35,13.79 20.7,14.15 20.84,14.01 20.84,13.51 v1(20.72,13.39) ; 20.35,13.79 20.64,13.5 20.72,13.5 v1(20.72,13.39) ; 19.64,13.09 19.98,12.74 ; 19.64,13.09 19.29,12.73 ; 19.64,13.09 19.25,13.48 v1(19.25,13.44) 19.2,13.39 19.2,13.35 18.93,13.09 ; 19.98,12.74 19.98,12.72 19.91,12.72 19.65,12.47 19.65,12.43 v1(19.63,12.4) ; 19.29,12.73 18.93,13.09 ; 19.29,12.73 19.61,12.4 v1(19.63,12.4) ; 19.29,12.73 18.93,12.38 ; 17.87,14.15 18.14,14.42 v1(18.23,14.42) ; 17.87,14.15 18.14,13.88 v1(18.14,13.75) ; 17.87,14.15 17.52,13.79 17.52,13.61 v1(17.74,13.39) 18.1,13.75 v1(18.14,13.75) ; 17.87,14.15 17.52,14.5 17.87,14.85 ; v1(40.72,12.01) 40.72,11.94 40.34,11.57 v1(40.68,11.23) 40.72,11.18 40.87,11.18 UD1.P12 41.71,10.92 v1(41.78,11) 42.07,10.71 C12.1 C4.1 ; 18.89,11.71 18.58,12.02 ; 18.89,11.71 18.94,11.71 v1(19.63,12.4) ; 18.22,11.67 18.58,12.02 ; 18.58,12.02 18.93,12.38 ; 18.58,12.02 18.22,12.38 18.58,12.73 ; v1(18.23,14.42) v1(18.57,14.07) 18.53,14.02 18.41,14.02 v1(18.14,13.75) ; v1(18.23,14.42) 17.87,14.77 17.87,14.85 ; C28.1 28.7,16.56 ; 28.7,16.56 v1(28.72,16.54) ; 28.7,16.56 28.17,17.09 C27.2 ; 37.94,9.62 v1(38.32,9.24) ; 20.7,16.97 20.7,17.02 20.36,17.36 ; 18.63,16.27 18.6,16.29 18.93,16.62 18.93,16.57 18.63,16.27 ; 18.63,16.27 18.6,16.24 18.93,15.91 ; 18.63,16.27 18.93,15.96 18.93,15.91 ; 18.93,13.09 18.58,12.73 ; v1(33.99,19.84) 33.99,19.41 33.94,19.37 ; v1(37.7,5.28) 37.94,5.53 37.94,5.72 ; v1(40.73,15.19) 40.78,15.19 ; 40.78,15.19 40.73,15.15 ; 40.78,15.19 41.05,15.47 41.55,15.47 v1(41.62,15.4) 42.04,15.4 C3.1 42.27,15.91 42.24,15.94 ; 20.36,17.36 20.37,17.36 ; 20.36,17.36 v1(20.35,17.37) ; 20.36,17.36 20.31,17.36 19.68,18 v1(19.68,18.07) ; 35.54,7.02 35.73,6.83 v1(36.04,6.83) ; C7.1 41.77,18.61 v1(41.56,18.39) 41.47,18.39 40.9,17.82 40.81,17.82 v1(40.77,17.78) 40.71,17.78 40.34,17.42 ; C18.1 C11.1 41.64,8.27 v1(41.58,8.33) 41.56,8.32 41.14,8.32 ; 18.93,12.38 18.58,12.73 ; 18.93,12.38 19.27,12.04 ; v1(31.79,15.66) 31.98,15.47 32.59,15.47 32.9,15.77 ; 38.74,17.42 38.69,17.42 v1(38.33,17.78) ; 33.94,15.47 33.8,15.47 v1(33.53,15.74) ; 22.11,14.15 22.11,13.99 v1(22.31,13.8) 22.11,13.6 22.11,13.44 21.96,13.59 21.49,13.59 21.02,13.12 20.75,13.39 v1(20.72,13.39) ; 37.94,15.47 38.27,15.8 v1(38.33,15.8) ; v1(35.15,11.29) 35.14,11.29 35.13,11.3 35,11.3 34.74,11.57 ; 21.05,15.91 21.76,15.21 21.76,15.17 v1(22.07,14.86) ; v1(40.81,9.95) 41.13,9.63 UD1.T12 ; 39.54,19.37 39.59,19.37 v1(39.91,19.04) ; v1(31.97,16.62) 32.12,16.77 32.34,16.77 ; 35.54,16.77 v1(36.01,17.23) ; v1(37.37,16.77) 37.94,16.77 ; v1(39.17,7.31) 39.09,7.31 38.74,7.67 38.8,7.72 38.91,7.72 v1(39.19,8) 39.12,8.07 39.12,9.19 v1(39.17,9.25) 39.17,9.27 UD1.T10 ; v1(32.01,9.29) 32.34,9.62 ; 33.94,10.92 34.37,10.49 34.37,10.08 v1(34.34,10.05) 34.34,10.05 34.34,10.01 33.94,9.62 34.35,9.21 34.35,8.69 34.34,8.69 v1(34.34,8.61) 34.34,8.07 34.74,7.67 ; 41.14,16.77 41.61,16.77 v1(41.73,16.89) 42.15,17.31 C17.1 ; 33.94,5.72 33.94,5.24 v1(33.93,5.23) ; 18.93,15.91 19.29,15.56 ; 38.74,13.52 39.02,13.79 39.11,13.79 v1(39.18,13.86) ; v1(41.81,5.82) 41.81,5.74 v1(41.4,5.34) ; v1(41.81,5.82) 41.81,6.35 40.79,7.36 v1(40.73,7.36) 40.43,7.67 40.34,7.67 ; v1(41.81,5.82) C2.2 ; 33.14,13.52 33.03,13.63 32.88,13.63 v1(32.79,13.72) ; v1(37.5,8.15) 37.66,8.32 37.94,8.32 ; 33.14,7.67 32.77,7.29 v1(32.77,7.26) 32.72,7.26 32.47,7.02 32.16,7.02 31.97,7.2 v1(31.9,7.2) ; UD1.J10 40.18,13.52 UD1.K11 40.42,13.52 v1(40.72,13.82) 41.07,14.17 UD1.J12 ; v1(35.89,9.78) 35.72,9.62 35.54,9.62 35.2,9.96 ; 24.24,12.02 24.47,11.78 24.54,11.78 24.56,11.76 v1(24.65,11.76) ; v1(39.96,5.33) 39.92,5.33 39.54,5.72 ; v1(26.68,13.89) 26.54,13.89 26.51,13.87 26.09,13.87 26.03,13.8 26.01,13.8 26,13.79 ; 35.54,8.32 35.85,8.32 36.04,8.51 36.06,8.51 v1(36.07,8.52) ; 37.94,18.07 37.76,18.07 v1(37.51,18.31) ; 33.94,14.17 33.7,14.41 v1(33.54,14.41) ; v1(22.38,19.94) 22.5,19.94 26.44,23.88 38.46,23.88 41,21.33 41.06,21.38 ; v1(37.64,7.31) 37.94,7.02 ; 22.82,10.61 22.82,10.58 23.22,10.19 v1(23.22,9.98) ; v1(37.24,14.12) 37.24,14.27 36.17,15.34 v1(36.1,15.34) 35.97,15.47 35.54,15.47 ; v1(35.13,13.77) 35.08,13.72 34.95,13.72 34.75,13.52 34.74,13.52 ; v1(31.8,8.32) 32.34,8.32 ; 17.44,15.89 v1(17.79,16.25) ; 19.64,10.26 19.96,10.58 20.01,10.58 v1(20.02,10.59) 20.02,10.64 20.35,10.96 20.41,10.96 20.72,11.28 v1(20.72,11.31) 20.76,11.31 21.05,11.61 21.05,11.67 21.38,12 v1(21.44,12) ; 33.14,11.57 32.9,11.57 v1(32.78,11.44) ; 40.13,15.15 39.99,15.15 v1(39.95,15.19) 39.67,15.47 39.54,15.47 39.23,15.78 39.13,15.87 39.13,16.3 39.17,16.33 39.17,16.38 v1(39.17,16.38) ; C1.2 C8.2 41.07,12.65 v1(40.77,12.95)